# Altium schematic sheet PROM21参考.schdoc
size 839 x 594 mm; Symbol: Sheet-Symbol_A4; Company: 嘉立创EDA; Version: V1.0; Page Size: A4; @Project Name: PROM21; @Page Count: 1; @Update Date: 2025-06-21; @Create Date: 2025-04-14; @Schematic Name: Schematic1_1; @Page No: 1; @Page Name: P1; Device: Sheet-Symbol_A4; @Board Name: Board3; @Create Time: 21:15:54; @Update Time: 14:47:36; Border: 1; Width: 3304; Height: 2338; Region Start: 1; X Region Count: 6; Y Region Count: 4; Blade Width: 10; Title Block Position: 3; Title Block: 1
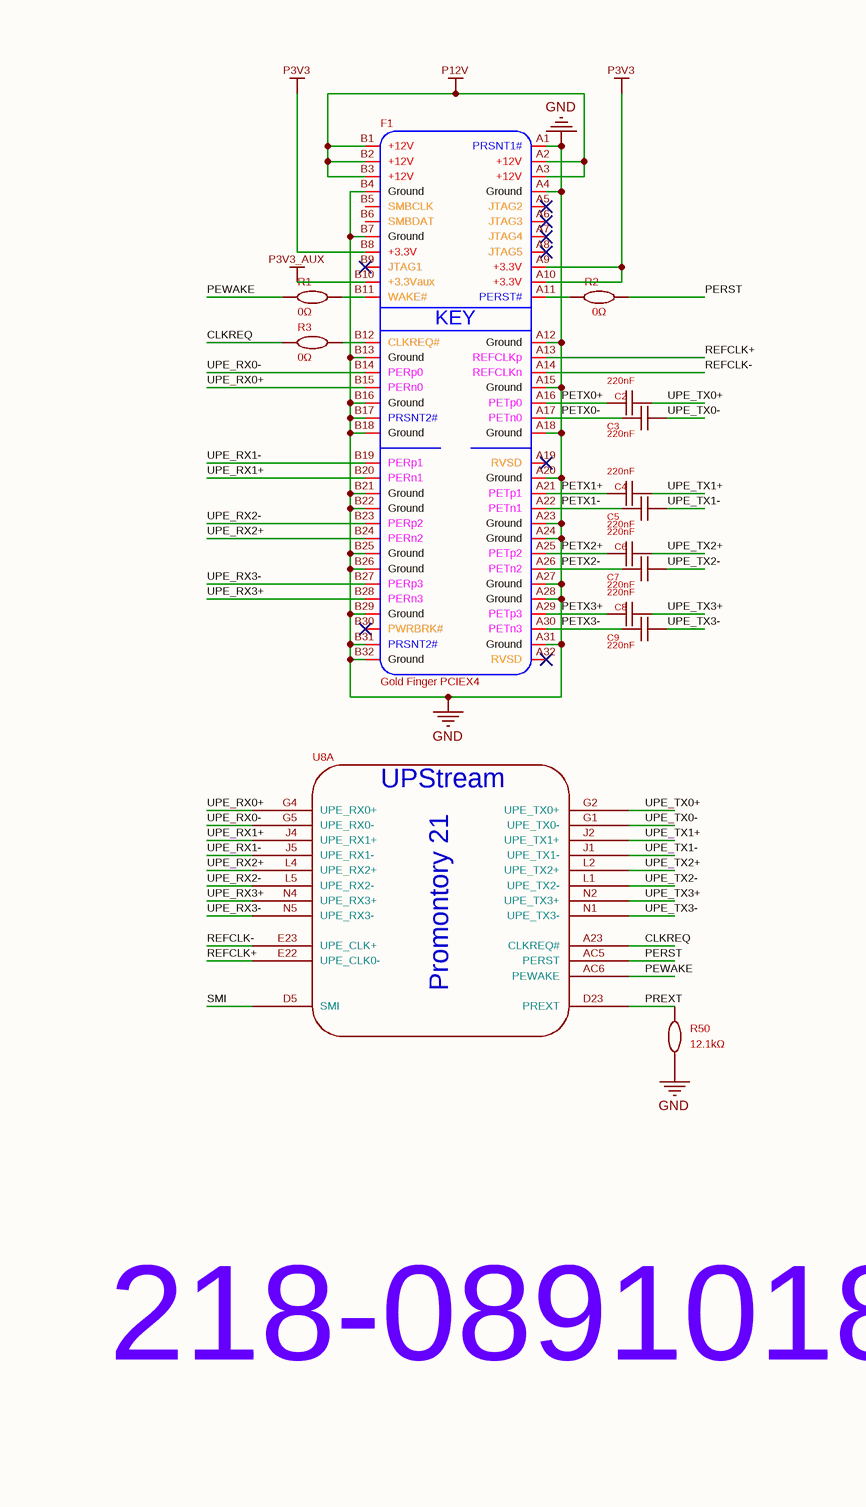
[diagram p0: PROM21参考.schdoc, top left]
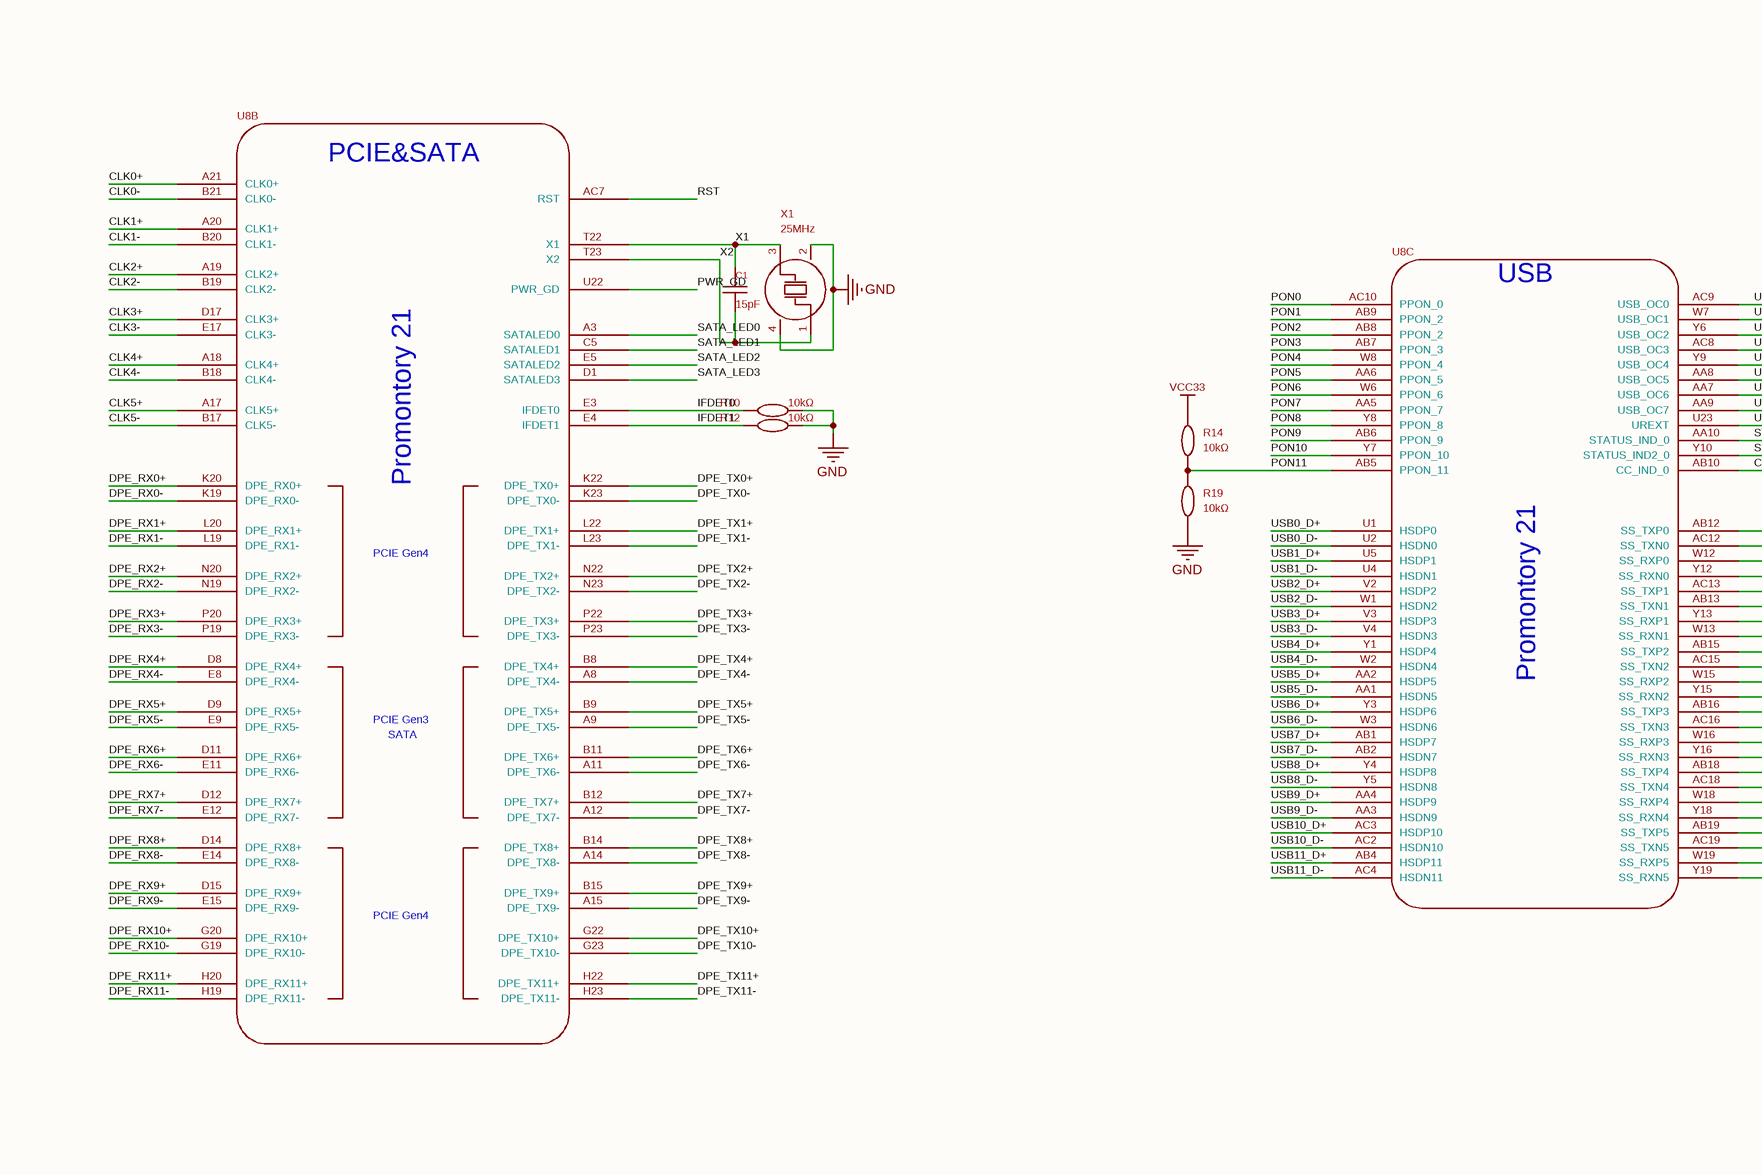
[diagram p1: PROM21参考.schdoc, top middle]
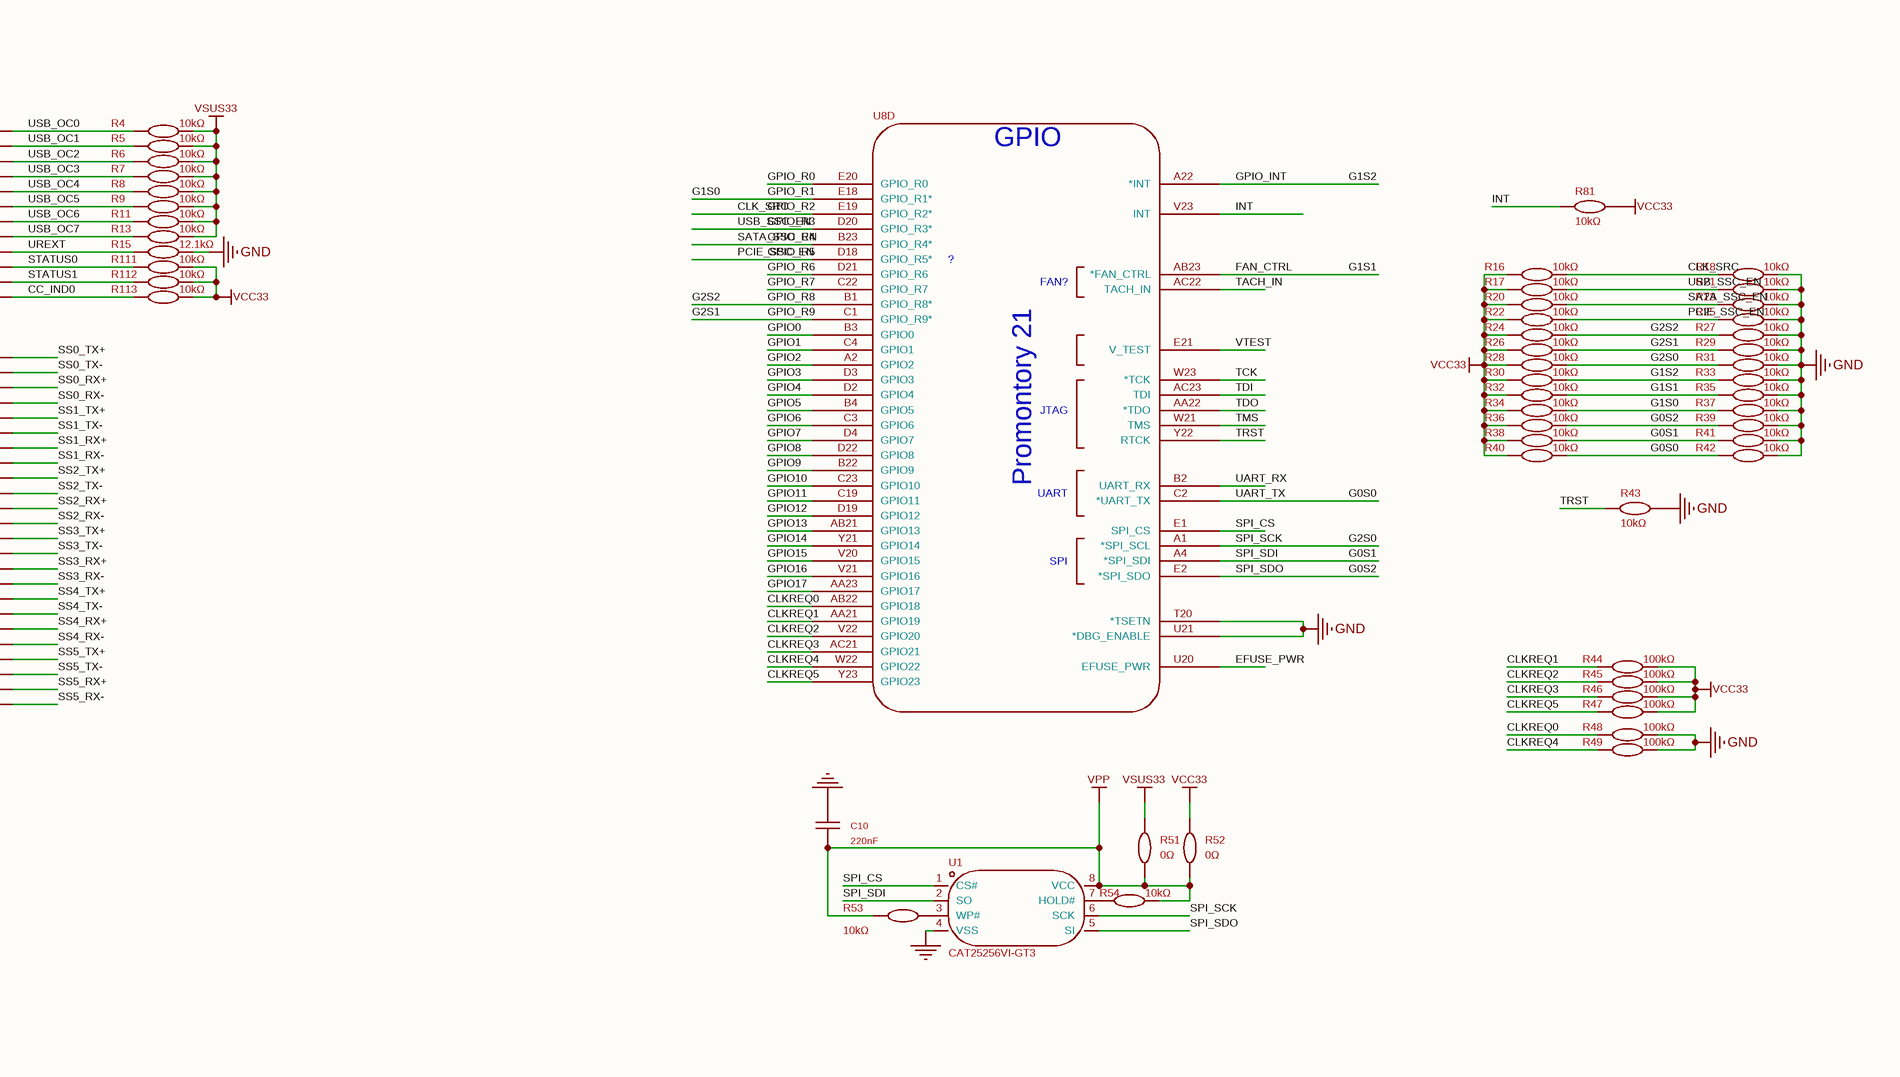
[diagram p2: PROM21参考.schdoc, top right]
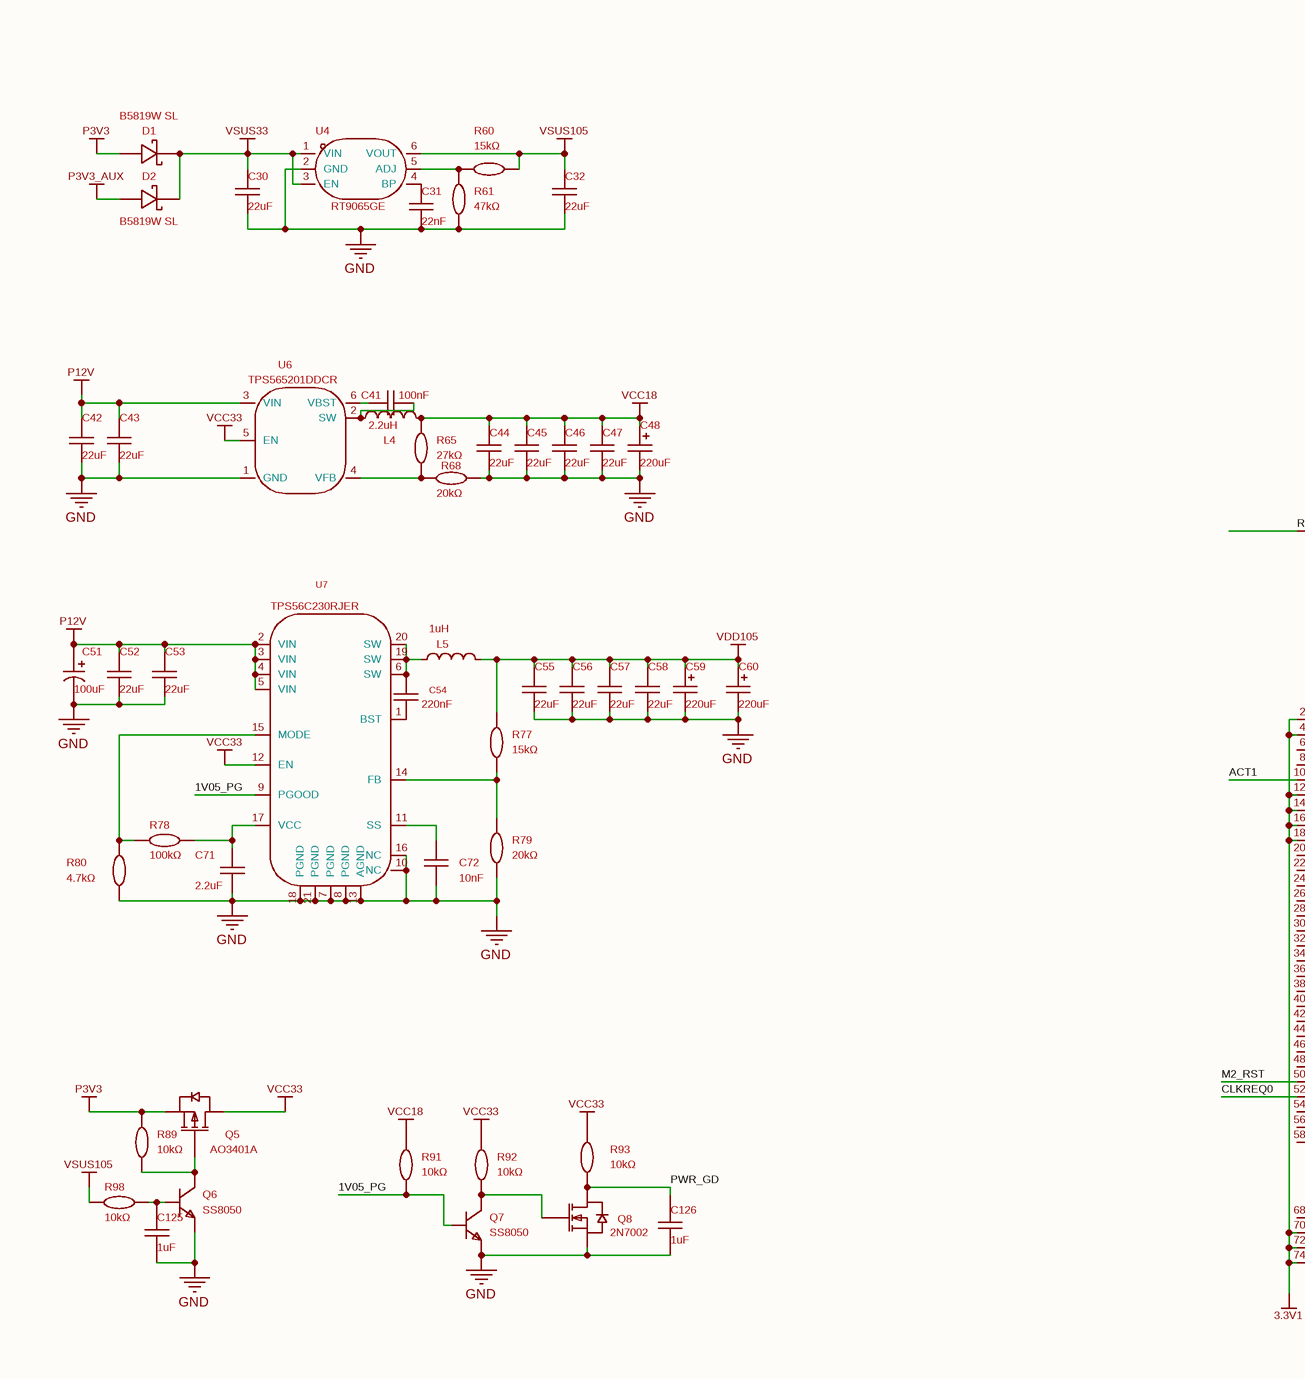
[diagram p3: PROM21参考.schdoc, bottom left]
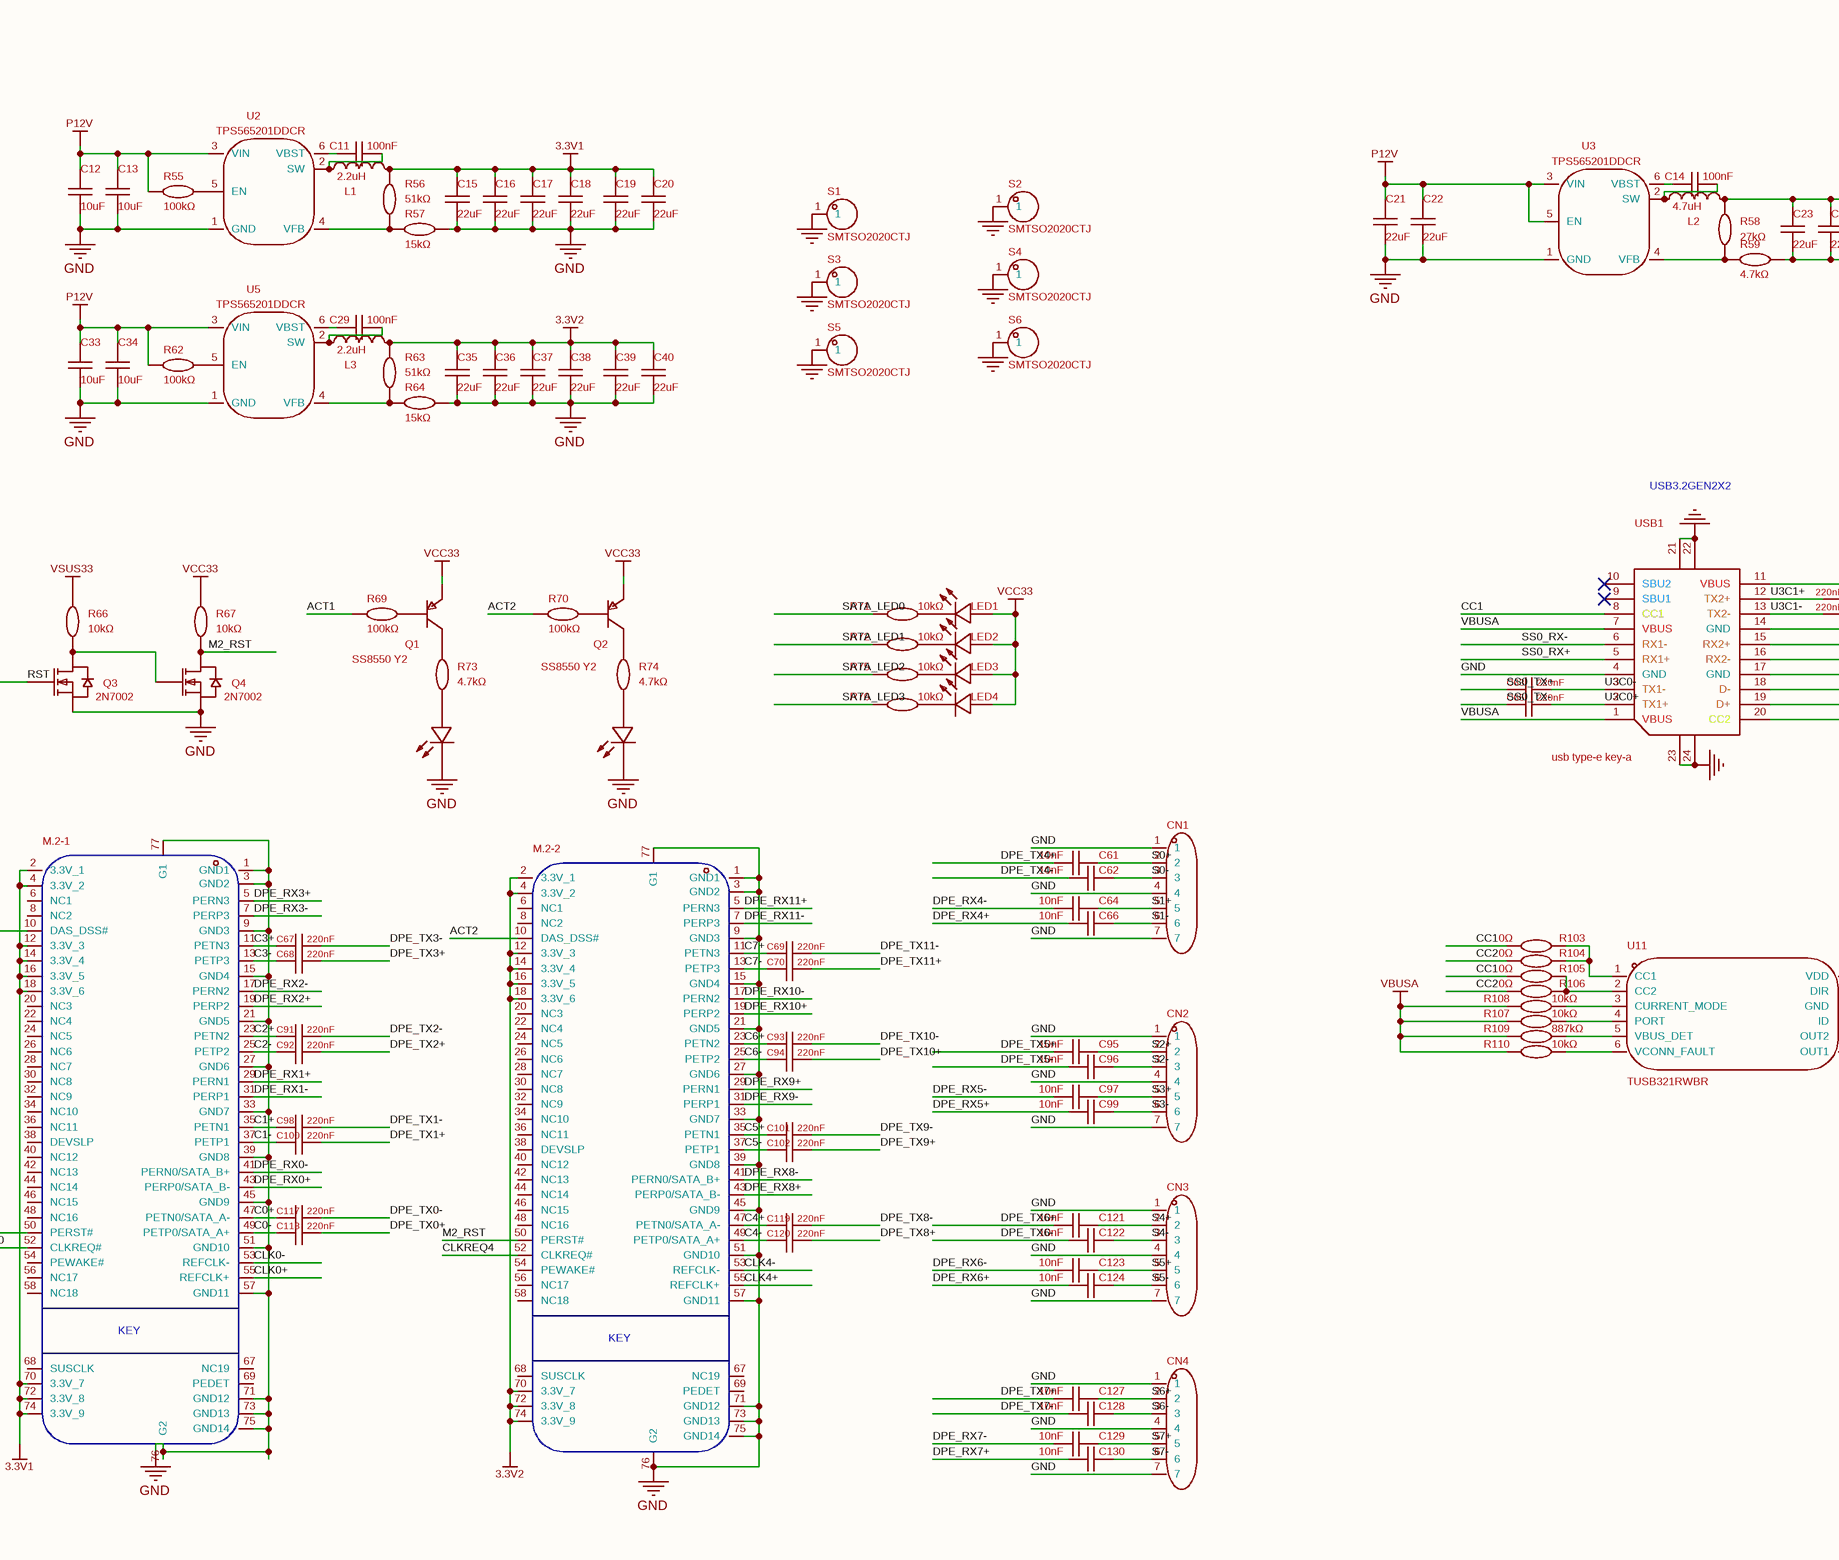
[diagram p4: PROM21参考.schdoc, bottom middle]
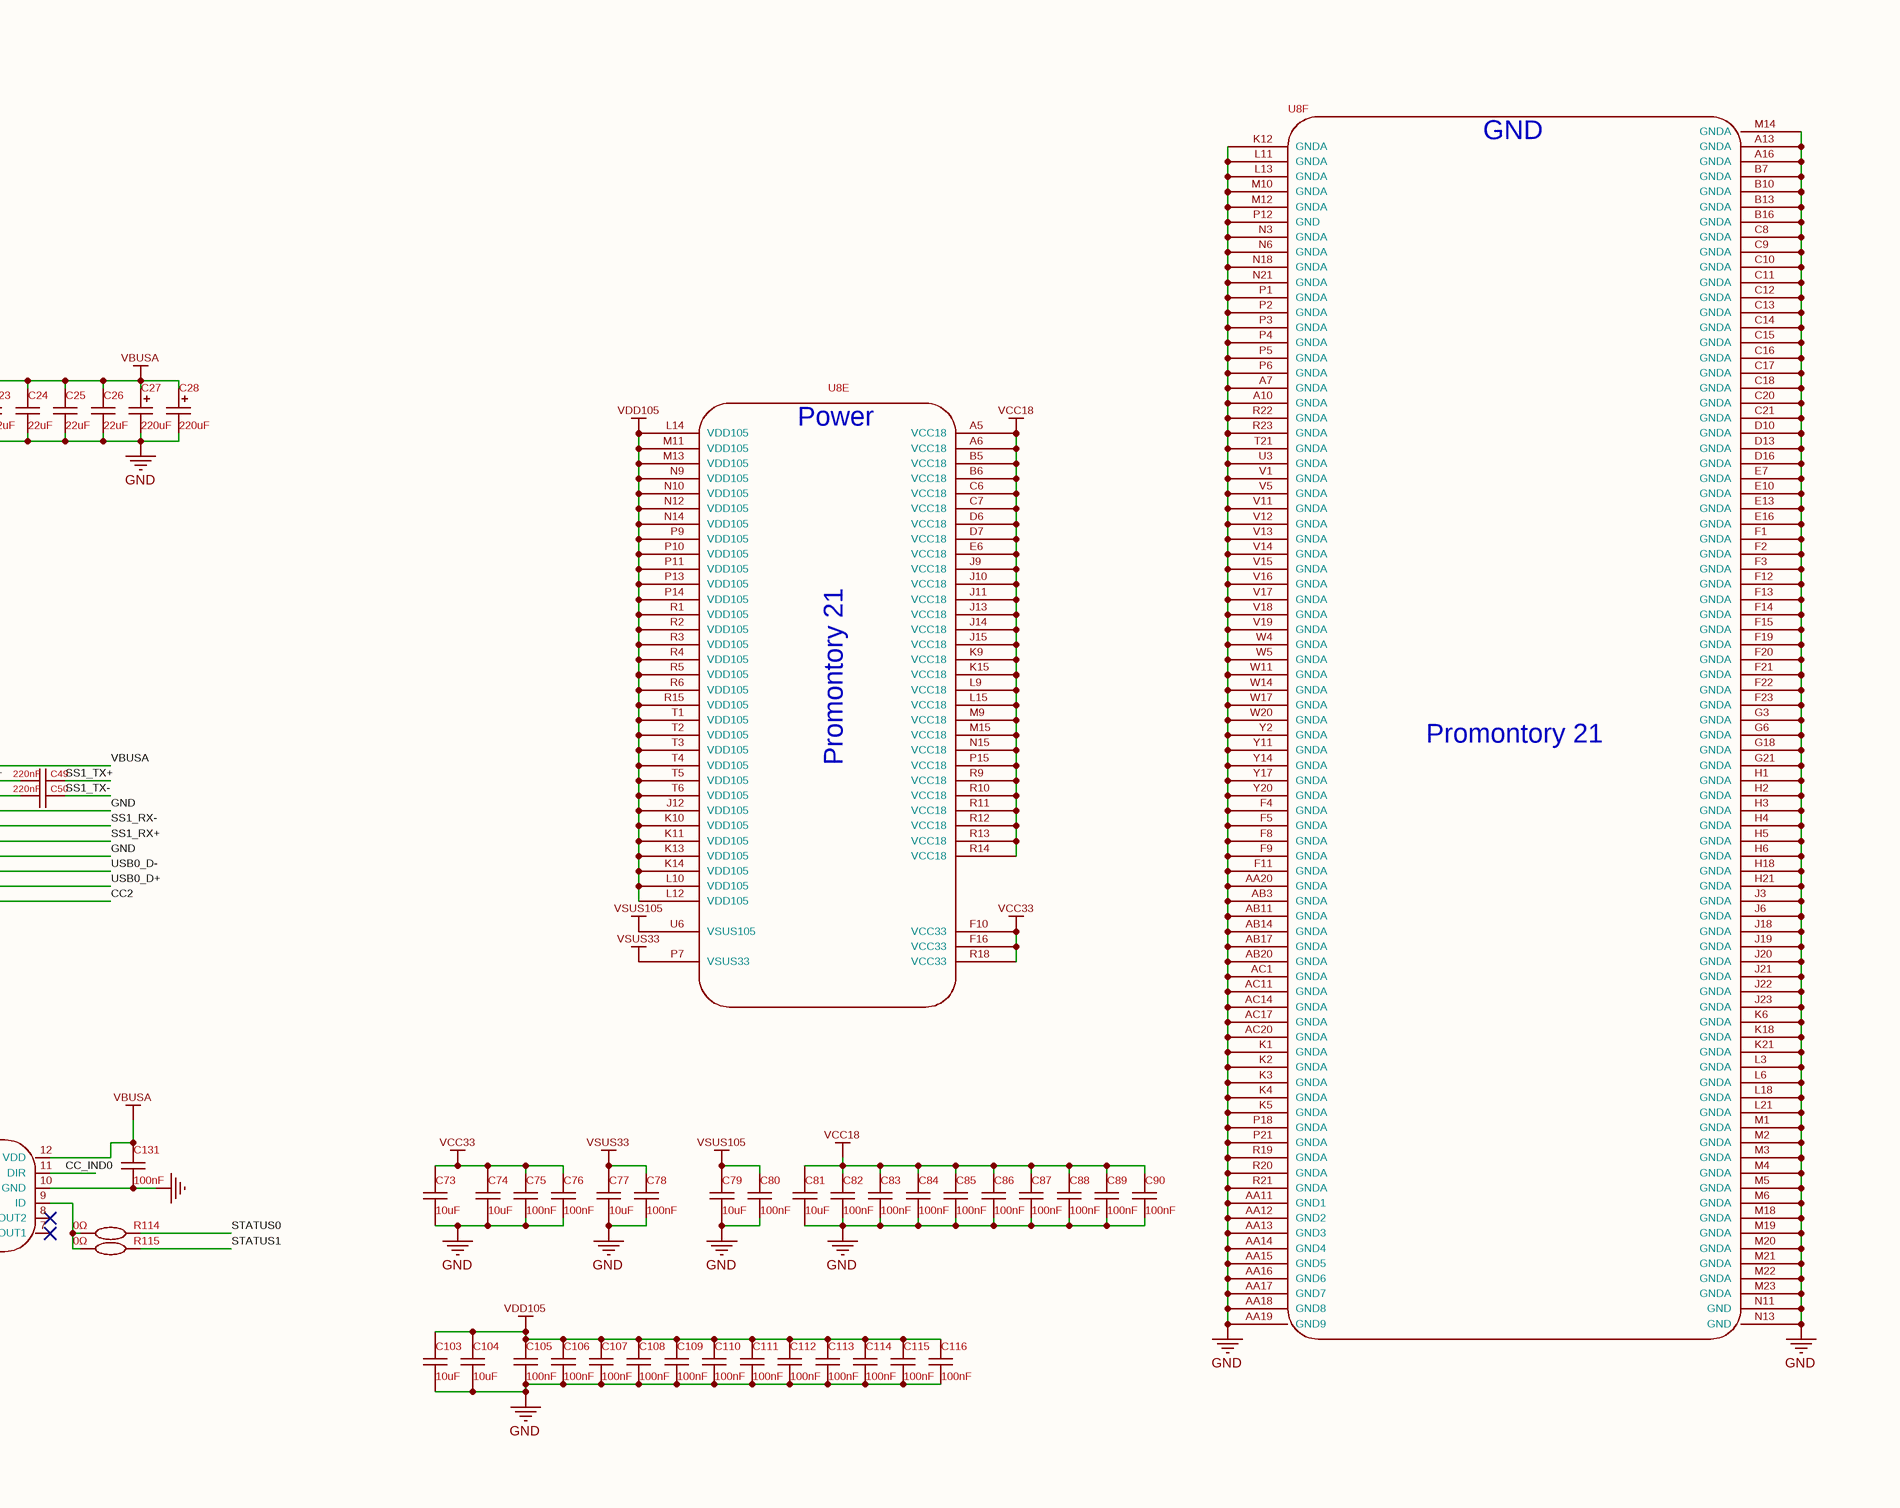
[diagram p5: PROM21参考.schdoc, bottom right]

## Parts
C1  15pF  [C0402]
C2  220nF  [C0402_BGA]
C3  220nF  [C0402_BGA]
C4  220nF  [C0402_BGA]
C5  220nF  [C0402_BGA]
C6  220nF  [C0402_BGA]
C7  220nF  [C0402_BGA]
C8  220nF  [C0402_BGA]
C9  220nF  [C0402_BGA]
C10  220nF  [C0402]
C11  100nF  [C0402]
C12  10uF  [C0805_1]
C13  10uF  [C0805_1]
C14  100nF  [C0402]
C15  22uF  [C0805]
C16  22uF  [C0805]
C17  22uF  [C0805]
C18  22uF  [C0805]
C19  22uF  [C0805]
C20  22uF  [C0805]
C21  22uF  [C1206]
C22  22uF  [C1206]
C23  22uF  [C0805]
C24  22uF  [C0805]
C25  22uF  [C0805]
C26  22uF  [C0805]
C27  220uF  [CAP-SMD_L3.5-W2.8-R-RD]
C28  220uF  [CAP-SMD_L3.5-W2.8-R-RD]
C29  100nF  [C0402]
C30  22uF  [C0805]
C31  22nF  [C0402]
C32  22uF  [C0805]
C33  10uF  [C0805_1]
C34  10uF  [C0805_1]
C35  22uF  [C0805]
C36  22uF  [C0805]
C37  22uF  [C0805]
C38  22uF  [C0805]
C39  22uF  [C0805]
C40  22uF  [C0805]
C41  100nF  [C0402]
C42  22uF  [C1206]
C43  22uF  [C1206]
C44  22uF  [C0805]
C45  22uF  [C0805]
C46  22uF  [C0805]
C47  22uF  [C0805]
C48  220uF  [CAP-SMD_L3.5-W2.8-R-RD]
C49  220nF  [C0402]
C50  220nF  [C0402]
C51  100uF  [CAP-SMD_BD6.3-L6.6-W6.6-LS7.2-FD]
C52  22uF  [C1206]
C53  22uF  [C1206]
C54  220nF  [C0402_1]
C55  22uF  [C0805]
C56  22uF  [C0805]
C57  22uF  [C0805]
C58  22uF  [C0805]
C59  220uF  [CAP-SMD_L3.5-W2.8-R-RD]
C60  220uF  [CAP-SMD_L3.5-W2.8-R-RD]
C61  10nF  [C0402]
C62  10nF  [C0402]
C63  220nF  [C0402]
C64  10nF  [C0402]
C65  220nF  [C0402]
C66  10nF  [C0402]
C67  220nF  [C0402_BGA]
C68  220nF  [C0402_BGA]
C69  220nF  [C0402_BGA]
C70  220nF  [C0402_BGA]
C71  2.2uF  [C0603]
C72  10nF  [C0402]
C73  10uF  [C0603]
C74  10uF  [C0603]
C75  100nF  [C0402_BGA]
C76  100nF  [C0402_BGA]
C77  10uF  [C0603]
C78  100nF  [C0402_BGA]
C79  10uF  [C0603]
C80  100nF  [C0402_BGA]
C81  10uF  [C0603]
C82  100nF  [C0402_BGA]
C83  100nF  [C0402_BGA]
C84  100nF  [C0402_BGA]
C85  100nF  [C0402_BGA]
C86  100nF  [C0402_BGA]
C87  100nF  [C0402_BGA]
C88  100nF  [C0402_BGA]
C89  100nF  [C0402_BGA]
C90  100nF  [C0402_BGA]
C91  220nF  [C0402_BGA]
C92  220nF  [C0402_BGA]
C93  220nF  [C0402_BGA]
C94  220nF  [C0402_BGA]
C95  10nF  [C0402]
C96  10nF  [C0402]
C97  10nF  [C0402]
C98  220nF  [C0402_BGA]
C99  10nF  [C0402]
C100  220nF  [C0402_BGA]
C101  220nF  [C0402_BGA]
C102  220nF  [C0402_BGA]
C103  10uF  [C0603]
C104  10uF  [C0603]
C105  100nF  [C0402_BGA]
C106  100nF  [C0402_BGA]
C107  100nF  [C0402_BGA]
C108  100nF  [C0402_BGA]
C109  100nF  [C0402_BGA]
C110  100nF  [C0402_BGA]
C111  100nF  [C0402_BGA]
C112  100nF  [C0402_BGA]
C113  100nF  [C0402_BGA]
C114  100nF  [C0402_BGA]
C115  100nF  [C0402_BGA]
C116  100nF  [C0402_BGA]
C117  220nF  [C0402_BGA]
C118  220nF  [C0402_BGA]
C119  220nF  [C0402_BGA]
C120  220nF  [C0402_BGA]
C121  10nF  [C0402]
C122  10nF  [C0402]
C123  10nF  [C0402]
C124  10nF  [C0402]
C125  1uF  [C0603]
C126  1uF  [C0603]
C127  10nF  [C0402]
C128  10nF  [C0402]
C129  10nF  [C0402]
C130  10nF  [C0402]
C131  100nF  [C0402_BGA]
CN1  HYCW02-SATA07-250B  [CONN-SMD_7P-P1.27_HYC_HYCW02-SATA07-250B]  (value not drawn)
CN2  HYCW02-SATA07-250B  [CONN-SMD_7P-P1.27_HYC_HYCW02-SATA07-250B]  (value not drawn)
CN3  HYCW02-SATA07-250B  [CONN-SMD_7P-P1.27_HYC_HYCW02-SATA07-250B]  (value not drawn)
CN4  HYCW02-SATA07-250B  [CONN-SMD_7P-P1.27_HYC_HYCW02-SATA07-250B]  (value not drawn)
D1  B5819W SL  [SOD-123_L2.7-W1.6-LS3.7-RD-1]
D2  B5819W SL  [SOD-123_L2.7-W1.6-LS3.7-RD-1]
F1  Gold Finger PCIEX4  [Gold Finger PCIEX4]
L1  2.2uH  [IND-SMD_L7.0-W6.6_MCW-0650-220]
L2  4.7uH  [IND-SMD_L8.5-W8.0_PSPMAA0803H-330M-ANP]
L3  2.2uH  [IND-SMD_L7.0-W6.6_MCW-0650-220]
L4  2.2uH  [IND-SMD_L5.4-W5.2]
L5  1uH  [IND-SMD_L7.0-W6.6]
LED1  KT-0603R  [LED0603-RD]  (value not drawn)
LED2  KT-0603R  [LED0603-RD]  (value not drawn)
LED3  KT-0603R  [LED0603-RD]  (value not drawn)
LED4  KT-0603R  [LED0603-RD]  (value not drawn)
LED5  KT-0603R  [LED0603-RD]  (value not drawn)
LED6  KT-0603R  [LED0603-RD]  (value not drawn)
M.2-1  (no value)  [conn-smd_91302-32-067rdm]
M.2-2  (no value)  [conn-smd_91302-32-067rdm]
Q1  SS8550 Y2  [SOT-23-3_L2.9-W1.3-P1.90-LS2.4-BR]
Q2  SS8550 Y2  [SOT-23-3_L2.9-W1.3-P1.90-LS2.4-BR]
Q3  2N7002  [SOT-23-3_L2.9-W1.3-P1.90-LS2.4-BR]
Q4  2N7002  [SOT-23-3_L2.9-W1.3-P1.90-LS2.4-BR]
Q5  AO3401A  [SOT-23_L2.9-W1.3-P1.90-LS2.4-BR]
Q6  SS8050  [SOT-23-3_L2.9-W1.3-P1.90-LS2.4-BR]
Q7  SS8050  [SOT-23-3_L2.9-W1.3-P1.90-LS2.4-BR]
Q8  2N7002  [SOT-23-3_L2.9-W1.3-P1.90-LS2.4-BR]
R1  0Ω  [R0603]
R2  0Ω  [R0603]
R3  0Ω  [R0603]
R4  10kΩ  [R0402]
R5  10kΩ  [R0402]
R6  10kΩ  [R0402]
R7  10kΩ  [R0402]
R8  10kΩ  [R0402]
R9  10kΩ  [R0402]
R10  10kΩ  [R0402]
R11  10kΩ  [R0402]
R12  10kΩ  [R0402]
R13  10kΩ  [R0402]
R14  10kΩ  [R0402]
R15  12.1kΩ  [R0402]
R16  10kΩ  [R0402]
R17  10kΩ  [R0402]
R18  10kΩ  [R0402]
R19  10kΩ  [R0402]
R20  10kΩ  [R0402]
R21  10kΩ  [R0402]
R22  10kΩ  [R0402]
R23  10kΩ  [R0402]
R24  10kΩ  [R0402]
R25  10kΩ  [R0402]
R26  10kΩ  [R0402]
R27  10kΩ  [R0402]
R28  10kΩ  [R0402]
R29  10kΩ  [R0402]
R30  10kΩ  [R0402]
R31  10kΩ  [R0402]
R32  10kΩ  [R0402]
R33  10kΩ  [R0402]
R34  10kΩ  [R0402]
R35  10kΩ  [R0402]
R36  10kΩ  [R0402]
R37  10kΩ  [R0402]
R38  10kΩ  [R0402]
R39  10kΩ  [R0402]
R40  10kΩ  [R0402]
R41  10kΩ  [R0402]
R42  10kΩ  [R0402]
R43  10kΩ  [R0402]
R44  100kΩ  [R0402]
R45  100kΩ  [R0402]
R46  100kΩ  [R0402]
R47  100kΩ  [R0402]
R48  100kΩ  [R0402]
R49  100kΩ  [R0402]
R50  12.1kΩ  [R0402]
R51  0Ω  [R0603]
R52  0Ω  [R0603]
R53  10kΩ  [R0402]
R54  10kΩ  [R0402]
R55  100kΩ  [R0402]
R56  51kΩ  [R0402_1]
R57  15kΩ  [R0402]
R58  27kΩ  [R0402]
R59  4.7kΩ  [R0402]
R60  15kΩ  [R0402]
R61  47kΩ  [R0402]
R62  100kΩ  [R0402]
R63  51kΩ  [R0402_1]
R64  15kΩ  [R0402]
R65  27kΩ  [R0402]
R66  10kΩ  [R0402]
R67  10kΩ  [R0402]
R68  20kΩ  [R0402]
R69  100kΩ  [R0402]
R70  100kΩ  [R0402]
R71  10kΩ  [R0402]
R72  10kΩ  [R0402]
R73  4.7kΩ  [R0402]
R74  4.7kΩ  [R0402]
R75  10kΩ  [R0402]
R76  10kΩ  [R0402]
R77  15kΩ  [R0402]
R78  100kΩ  [R0402]
R79  20kΩ  [R0402]
R80  4.7kΩ  [R0402]
R81  10kΩ  [R0402]
R89  10kΩ  [R0603]
R91  10kΩ  [R0603]
R92  10kΩ  [R0603]
R93  10kΩ  [R0603]
R98  10kΩ  [R0603]
R103  0Ω  [R0603]
R104  0Ω  [R0603]
R105  0Ω  [R0603]
R106  0Ω  [R0603]
R107  10kΩ  [R0402]
R108  10kΩ  [R0402]
R109  887kΩ  [R0402_1]
R110  10kΩ  [R0402]
R111  10kΩ  [R0402]
R112  10kΩ  [R0402]
R113  10kΩ  [R0402]
R114  0Ω  [R0603]
R115  0Ω  [R0603]
S1  SMTSO2020CTJ  [SMD_BD5.0-D3.5]
S2  SMTSO2020CTJ  [SMD_BD5.0-D3.5]
S3  SMTSO2020CTJ  [SMD_BD5.0-D3.5]
S4  SMTSO2020CTJ  [SMD_BD5.0-D3.5]
S5  SMTSO2020CTJ  [SMD_BD5.0-D3.5]
S6  SMTSO2020CTJ  [SMD_BD5.0-D3.5]
U1  CAT25256VI-GT3  [SOIC-8_L5.0-W4.0-P1.27-LS6.0-BL]
U2  TPS565201DDCR  [TSOT-23-6_L2.9-W1.6-P0.95-LS2.8-BL]
U3  TPS565201DDCR  [TSOT-23-6_L2.9-W1.6-P0.95-LS2.8-BL]
U4  RT9065GE  [SOT-23-6_L2.9-W1.6-P0.95-LS2.8-BL]
U5  TPS565201DDCR  [TSOT-23-6_L2.9-W1.6-P0.95-LS2.8-BL]
U6  TPS565201DDCR  [TSOT-23-6_L2.9-W1.6-P0.95-LS2.8-BL]
U7  TPS56C230RJER  [VQFN-20_L3.0-W3.0-P0.45-TL-EP_TI_RJE]
U8  (no value)  [PROM21]  (parts A,B,C,D,E,F of 6)
U11  TUSB321RWBR  [X2QFN-12_L1.6-W1.6-P0.40-TL]
USB1  usb type-e key-a  [USB 3.1 FRONT-PANEL KEYA]
X1  25MHz  [OSC-SMD_4P-L3.2-W2.5-BL]

## Nets
3.3V1: C15.2 C16.2 C17.2 C18.2 C19.2 C20.2 L1.2 M.2-1.2(3.3V_1) M.2-1.4(3.3V_2) M.2-1.12(3.3V_3) M.2-1.14(3.3V_4) M.2-1.16(3.3V_5) M.2-1.18(3.3V_6) M.2-1.70(3.3V_7) M.2-1.72(3.3V_8) M.2-1.74(3.3V_9) R56.2
3.3V2: C35.2 C36.2 C37.2 C38.2 C39.2 C40.2 L3.2 M.2-2.2(3.3V_1) M.2-2.4(3.3V_2) M.2-2.12(3.3V_3) M.2-2.14(3.3V_4) M.2-2.16(3.3V_5) M.2-2.18(3.3V_6) M.2-2.70(3.3V_7) M.2-2.72(3.3V_8) M.2-2.74(3.3V_9) R63.2
GND: C2.1 C3.1 C4.1 C5.1 C6.1 C7.1 C8.1 C9.1 C10.2 C12.1 C13.1 C15.1 C16.1 C17.1 C18.1 C19.1 C20.1 C21.1 C22.1 C23.1 C24.1 C25.1 C26.1 C27.2 C28.2 C30.1 C31.1 C32.1 C33.1 C34.1 C35.1 C36.1 C37.1 C38.1 C39.1 C40.1 C42.1 C43.1 C44.1 C45.1 C46.1 C47.1 C48.2 C51.2 C52.1 C53.1 C55.1 C56.1 C57.1 C58.1 C59.2 C60.2 C71.1 C72.1 C73.1 C74.1 C75.1 C76.1 C77.1 C78.1 C79.1 C80.1 C81.1 C82.1 C83.1 C84.1 C85.1 C86.1 C87.1 C88.1 C89.1 C90.1 C103.1 C104.1 C105.1 C106.1 C107.1 C108.1 C109.1 C110.1 C111.1 C112.1 C113.1 C114.1 C115.1 C116.1 C125.1 C126.1 C131.1 CN1.1 CN1.4 CN1.7 CN2.1 CN2.4 CN2.7 CN3.1 CN3.4 CN3.7 CN4.1 CN4.4 CN4.7 F1.A1(PRSNT1#) F1.A4(Ground) F1.A12(Ground) F1.A15(Ground) F1.A16(PETp0) F1.A17(PETn0) F1.A18(Ground) F1.A20(Ground) F1.A21(PETp1) F1.A22(PETn1) F1.A23(Ground) F1.A24(Ground) F1.A25(PETp2) F1.A26(PETn2) F1.A27(Ground) F1.A28(Ground) F1.A29(PETp3) F1.A30(PETn3) F1.A31(Ground) F1.B4(Ground) F1.B7(Ground) F1.B13(Ground) F1.B16(Ground) F1.B17(PRSNT2#) F1.B18(Ground) F1.B21(Ground) F1.B22(Ground) F1.B25(Ground) F1.B26(Ground) F1.B29(Ground) F1.B31(PRSNT2#) F1.B32(Ground) LED5.1(K) LED6.1(K) M.2-1.1(GND1) M.2-1.3(GND2) M.2-1.9(GND3) M.2-1.15(GND4) M.2-1.21(GND5) M.2-1.27(GND6) M.2-1.33(GND7) M.2-1.39(GND8) M.2-1.45(GND9) M.2-1.51(GND10) M.2-1.57(GND11) M.2-1.71(GND12) M.2-1.73(GND13) M.2-1.75(GND14) M.2-1.76(G2) M.2-1.77(G1) M.2-2.1(GND1) M.2-2.3(GND2) M.2-2.9(GND3) M.2-2.15(GND4) M.2-2.21(GND5) M.2-2.27(GND6) M.2-2.33(GND7) M.2-2.39(GND8) M.2-2.45(GND9) M.2-2.51(GND10) M.2-2.57(GND11) M.2-2.71(GND12) M.2-2.73(GND13) M.2-2.75(GND14) M.2-2.76(G2) M.2-2.77(G1) Q3.2(S) Q4.2(S) Q6.2(E) Q7.2(E) Q8.2(S) R10.2 R12.2 R15.2 R18.1 R19.1 R21.1 R23.1 R25.1 R27.1 R29.1 R31.1 R33.1 R35.1 R37.1 R39.1 R41.1 R42.1 R43.1 R48.2 R49.2 R50.1 R57.2 R59.1 R61.1 R64.2 R68.2 R79.1 R80.1 S1.1 S2.1 S3.1 S4.1 S5.1 S6.1 U1.4(VSS) U2.1(GND) U3.1(GND) U4.2(GND) U5.1(GND) U6.1(GND) U7.7(PGND) U7.8(PGND) U7.10(NC) U7.13(AGND) U7.16(NC) U7.18(PGND) U7.21(PGND) U8.A7(GNDA) U8.A10(GNDA) U8.A13(GNDA) U8.A16(GNDA) U8.AA11(GND1) U8.AA12(GND2) U8.AA13(GND3) U8.AA14(GND4) U8.AA15(GND5) U8.AA16(GND6) U8.AA17(GND7) U8.AA18(GND8) U8.AA19(GND9) U8.AA20(GNDA) U8.AB3(GNDA) U8.AB11(GNDA) U8.AB14(GNDA) U8.AB17(GNDA) U8.AB20(GNDA) U8.AC1(GNDA) U8.AC11(GNDA) U8.AC14(GNDA) U8.AC17(GNDA) U8.AC20(GNDA) U8.B7(GNDA) U8.B10(GNDA) U8.B13(GNDA) U8.B16(GNDA) U8.C8(GNDA) U8.C9(GNDA) U8.C10(GNDA) U8.C11(GNDA) U8.C12(GNDA) U8.C13(GNDA) U8.C14(GNDA) U8.C15(GNDA) U8.C16(GNDA) U8.C17(GNDA) U8.C18(GNDA) U8.C20(GNDA) U8.C21(GNDA) U8.D10(GNDA) U8.D13(GNDA) U8.D16(GNDA) U8.E7(GNDA) U8.E10(GNDA) U8.E13(GNDA) U8.E16(GNDA) U8.F1(GNDA) U8.F2(GNDA) U8.F3(GNDA) U8.F4(GNDA) U8.F5(GNDA) U8.F8(GNDA) U8.F9(GNDA) U8.F11(GNDA) U8.F12(GNDA) U8.F13(GNDA) U8.F14(GNDA) U8.F15(GNDA) U8.F19(GNDA) U8.F20(GNDA) U8.F21(GNDA) U8.F22(GNDA) U8.F23(GNDA) U8.G3(GNDA) U8.G6(GNDA) U8.G18(GNDA) U8.G21(GNDA) U8.H1(GNDA) U8.H2(GNDA) U8.H3(GNDA) U8.H4(GNDA) U8.H5(GNDA) U8.H6(GNDA) U8.H18(GNDA) U8.H21(GNDA) U8.J3(GNDA) U8.J6(GNDA) U8.J18(GNDA) U8.J19(GNDA) U8.J20(GNDA) U8.J21(GNDA) U8.J22(GNDA) U8.J23(GNDA) U8.K1(GNDA) U8.K2(GNDA) U8.K3(GNDA) U8.K4(GNDA) U8.K5(GNDA) U8.K6(GNDA) U8.K12(GNDA) U8.K18(GNDA) U8.K21(GNDA) U8.L3(GNDA) U8.L6(GNDA) U8.L11(GNDA) U8.L13(GNDA) U8.L18(GNDA) U8.L21(GNDA) U8.M1(GNDA) U8.M2(GNDA) U8.M3(GNDA) U8.M4(GNDA) U8.M5(GNDA) U8.M6(GNDA) U8.M10(GNDA) U8.M12(GNDA) U8.M14(GNDA) U8.M18(GNDA) U8.M19(GNDA) U8.M20(GNDA) U8.M21(GNDA) U8.M22(GNDA) U8.M23(GNDA) U8.N3(GNDA) U8.N6(GNDA) U8.N11(GND) U8.N13(GND) U8.N18(GNDA) U8.N21(GNDA) U8.P1(GNDA) U8.P2(GNDA) U8.P3(GNDA) U8.P4(GNDA) U8.P5(GNDA) U8.P6(GNDA) U8.P12(GND) U8.P18(GNDA) U8.P21(GNDA) U8.R19(GNDA) U8.R20(GNDA) U8.R21(GNDA) U8.R22(GNDA) U8.R23(GNDA) U8.T20(*TSETN) U8.T21(GNDA) U8.U3(GNDA) U8.U21(*DBG_ENABLE) U8.V1(GNDA) U8.V5(GNDA) U8.V11(GNDA) U8.V12(GNDA) U8.V13(GNDA) U8.V14(GNDA) U8.V15(GNDA) U8.V16(GNDA) U8.V17(GNDA) U8.V18(GNDA) U8.V19(GNDA) U8.W4(GNDA) U8.W5(GNDA) U8.W11(GNDA) U8.W14(GNDA) U8.W17(GNDA) U8.W20(GNDA) U8.Y2(GNDA) U8.Y11(GNDA) U8.Y14(GNDA) U8.Y17(GNDA) U8.Y20(GNDA) U11.10(GND) USB1.4(GND) USB1.14(GND) USB1.17(GND) USB1.21(SHIELD) USB1.22(SHIELD) USB1.23(SHIELD) USB1.24(SHIELD) X1.2(GND) X1.4(GND)  [also labelled PETX0+, PETX0-, PETX1+, PETX1-, PETX2+, PETX2-, PETX3+, PETX3-]